# EasyEDA Pro project balance_car.eprj, schematic Schematic2
Board Name: 2_电源板; Create Date: 2024-08-03; Page Name: P1; Project Name: balance_car; Schematic Name: Schematic2; Update Date: 2024-08-20
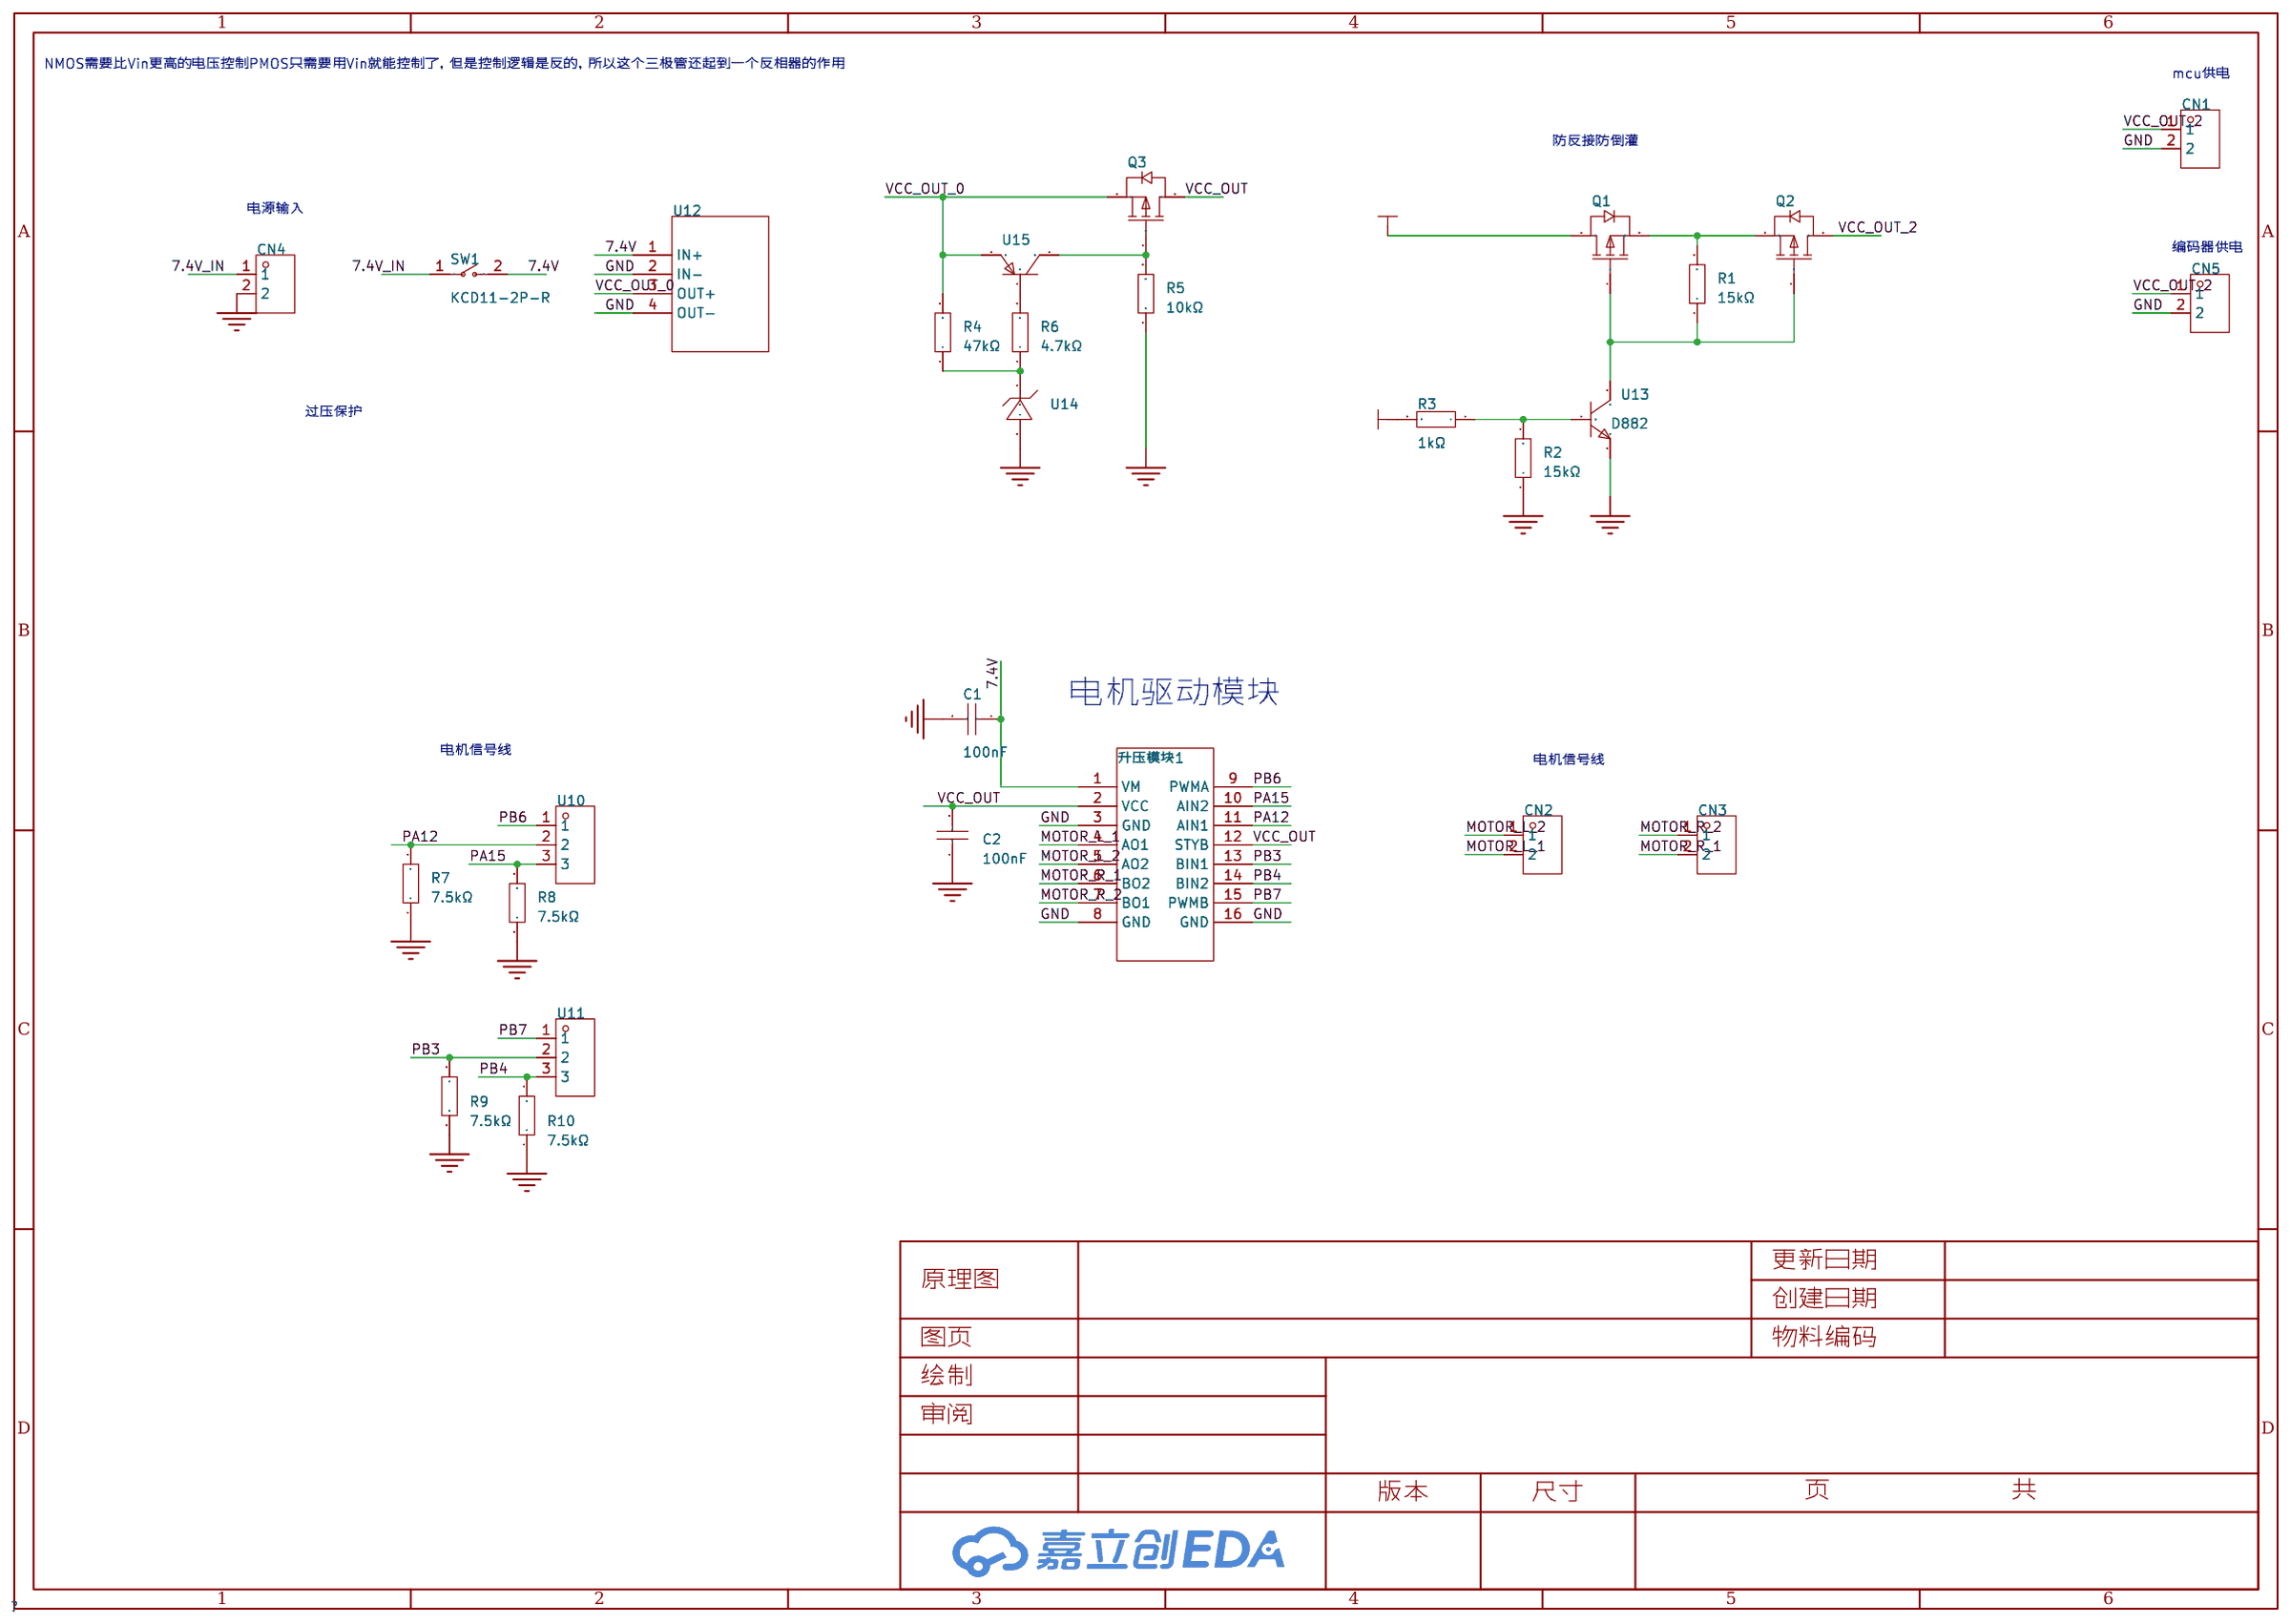
[diagram p0: schematic sheet]

## Parts
C1  100nF  [C1206]
C2  100nF  [C1206]
CN1  ZX-XH2.54-2PZZ  [CONN-TH_2P-P2.50_HX25003-2A]
CN2  ZX-XH2.54-2PZZ  [CONN-TH_2P-P2.50_HX25003-2A]
CN3  ZX-XH2.54-2PZZ  [CONN-TH_2P-P2.50_HX25003-2A]
CN4  ZX-XH2.54-2PZZ  [CONN-TH_2P-P2.50_HX25003-2A]
CN5  ZX-XH2.54-2PZZ  [CONN-TH_2P-P2.50_HX25003-2A]
Q1  AO3401A  [SOT-23_L2.9-W1.3-P1.90-LS2.4-BR]
Q2  AO3401A  [SOT-23_L2.9-W1.3-P1.90-LS2.4-BR]
Q3  AO3401A  [SOT-23_L2.9-W1.3-P1.90-LS2.4-BR]
R1  15kΩ  [R0805]
R2  15kΩ  [R0805]
R3  1kΩ  [R0805]
R4  47kΩ  [R0805]
R5  10kΩ  [R0805]
R6  4.7kΩ  [R0805]
R7  7.5kΩ  [R0603]
R8  7.5kΩ  [R0603]
R9  7.5kΩ  [R0603]
R10  7.5kΩ  [R0603]
SW1  KCD11-2P-R  [SW-TH_2P-L15.0-W10.5-P5.00_KCD11-2P-R]
U10  ZX-XH2.54-3PZZ  [CONN-TH_3P-P2.54_2501S-3P]
U11  ZX-XH2.54-3PZZ  [CONN-TH_3P-P2.54_2501S-3P]
U12  -  [buck_tb]
U13  D882  [SOT-89-3_L4.5-W2.5-P1.50-LS4.0-BR]
U14  ZMM4V7  [LL-34_L3.5-W1.5-RD]
U15  SS8550  [SOT-23-3_L2.9-W1.3-P1.90-LS2.4-BR]
升压模块1  -  [TB6612FNG]

## Library data of the parts
C1 C2 = GRM31C5C1H104JA01L: LCSC Part Name: 100nF ±5% 50V; Supplier Part: C97946; Manufacturer: muRata(村田); Supplier Footprint: 1206; JLCPCB Part Class: 扩展库; Datasheet: https://atta.szlcsc.com/upload/public/pdf/source/20180228/C97946_15198056954501377706.pdf; Supplier: LCSC; Tolerance: ±5%; Voltage Rated: 50V; Temperature Coefficient: C0G
CN1-CN5 = ZX-XH2.54-2PZZ: 插针结构:1x2P;间距:2.54mm;安装方式:直插;参考系列:XH;总PIN数:2P;排数:1;每排PIN数:2;行距:-;额定电流:3A;触头材质:黄铜;触头镀层:锡;工作温度范围:-25℃~+85℃;; Supplier Part: C7429632; Manufacturer: Megastar(兆星); Supplier Footprint: 插件,P=2.54mm; JLCPCB Part Class: 扩展库; Datasheet: https://atta.szlcsc.com/upload/public/pdf/source/20230619/19BA6947230AA44A04D3EDD65E618FD0.pdf; Supplier: LCSC; Pins Structure: 1x2P; Pitch: 2.54mm; Mounting Style: 直插; Reference Series: XH; Number of Pins: 2P; Number of Rows: 1; Number of PINs Per Row: 2; Current Rating (Max): 3A; Contact Material: 黄铜; Contact Plating: 锡; Operating Temperature Range: -25℃~+85℃
Q1-Q3 = AO3401A_C15127: LCSC Part Name: 1个P沟道 耐压:30V 电流:4A; Supplier Part: C15127; Manufacturer: AOS; Supplier Footprint: SOT-23; JLCPCB Part Class: 基础库; Datasheet: https://atta.szlcsc.com/upload/public/pdf/source/20160507/1462613609053.pdf; Supplier: LCSC; Type: 1个P沟道; Drain Source Voltage (Vdss): 30V; Continuous Drain Current (Id): 4A; Power Dissipation (Pd): 1.4W; Drain Source On Resistance (RDS(on)@Vgs,Id): 44mΩ@10V,4.3A; Gate Threshold Voltage (Vgs(th)@Id): 1.3V@250uA; Total Gate Charge (Qg@Vgs): 12.2nC@4.5V; Input Capacitance (Ciss@Vds): 1.2nF@15V; Operating Temperature: -55℃~+150℃@(Tj)
R1-R3 R5 = 0805W8J0103T5E: LCSC Part Name: 10kΩ ±5% 125mW 厚膜电阻; Supplier Part: C25612; Manufacturer: UNI-ROYAL(厚声); Supplier Footprint: 0805; JLCPCB Part Class: 扩展库; Datasheet: https://atta.szlcsc.com/upload/public/pdf/source/20200306/C422600_1E6D84923E4A46A82E41ADD87F860B5C.pdf; Supplier: LCSC; Type: 厚膜电阻; Tolerance: ±5%; Power(Watts): 125mW; Overload Voltage (Max): 150V; Temperature Coefficient: ±100ppm/℃; Operating Temperature Range: -55℃~+155℃
R4 = 0805W8F4702T5E: LCSC Part Name: 47kΩ ±1% 125mW 厚膜电阻; Supplier Part: C17713; Manufacturer: UNI-ROYAL(厚声); Supplier Footprint: 0805; JLCPCB Part Class: 基础库; Datasheet: https://atta.szlcsc.com/upload/public/pdf/source/20200306/C422600_1E6D84923E4A46A82E41ADD87F860B5C.pdf; Supplier: LCSC; Type: 厚膜电阻; Tolerance: ±1%; Power(Watts): 125mW; Overload Voltage (Max): 150V; Temperature Coefficient: ±100ppm/℃; Operating Temperature Range: -55℃~+155℃
R6 = 0805W8F4701T5E: LCSC Part Name: 4.7kΩ ±1% 125mW 厚膜电阻; Supplier Part: C17673; Manufacturer: UNI-ROYAL(厚声); Supplier Footprint: 0805; JLCPCB Part Class: 基础库; Datasheet: https://atta.szlcsc.com/upload/public/pdf/source/20200306/C422600_1E6D84923E4A46A82E41ADD87F860B5C.pdf; Supplier: LCSC; Type: 厚膜电阻; Tolerance: ±1%; Power(Watts): 125mW; Overload Voltage (Max): 150V; Temperature Coefficient: ±100ppm/℃; Operating Temperature Range: -55℃~+155℃
R7-R10 = 0603WAF7501T5E: LCSC Part Name: 7.5kΩ ±1% 100mW 厚膜电阻; Supplier Part: C23234; Manufacturer: UNI-ROYAL(厚声); Supplier Footprint: 0603; JLCPCB Part Class: 基础库; Datasheet: https://atta.szlcsc.com/upload/public/pdf/source/20200306/C422600_1E6D84923E4A46A82E41ADD87F860B5C.pdf; Supplier: LCSC; Type: 厚膜电阻; Tolerance: ±1%; Power(Watts): 100mW; Overload Voltage (Max): 75V; Temperature Coefficient: ±100ppm/℃; Operating Temperature Range: -55℃~+155℃
SW1 = KCD11-2P-R: LCSC Part Name: 10.5*15mm 两脚两档跷板开关 红钮; Supplier Part: C5884414; Manufacturer: SHOU HAN(首韩); Supplier Footprint: 插件; JLCPCB Part Class: 扩展库; Datasheet: https://atta.szlcsc.com/upload/public/pdf/source/20230506/CD06DFDE35C8048D34175BFF4AF6A2C2.pdf; Supplier: LCSC; Switch Length: 15mm; Switch Width: 10.5mm; Switch Height: 17.2mm; Actuator Type: 凹面弯曲; With Lamp: 无; Pin Style: 焊片; Actuator Color: 红色; Contact Current: 3A; Voltage Rating (AC): 250V; Circuit: 单刀单掷; Mechanical Life: 1万次; Operating Temperature: 0℃~+125℃; Actuator Identifier: - O
U10 U11 = ZX-XH2.54-3PZZ: 插针结构:1x3P;间距:2.54mm;安装方式:直插;参考系列:XH;总PIN数:3P;排数:1;每排PIN数:3;行距:-;额定电流:3A;触头材质:黄铜;触头镀层:锡;工作温度范围:-25℃~+85℃;; Supplier Part: C7429633; Manufacturer: Megastar(兆星); Supplier Footprint: 插件,P=2.54mm; JLCPCB Part Class: 扩展库; Datasheet: https://atta.szlcsc.com/upload/public/pdf/source/20230619/AE17037A2CFDBE8D9CBA775D61AD0A84.pdf; Supplier: LCSC; Pins Structure: 1x3P; Pitch: 2.54mm; Mounting Style: 直插; Reference Series: XH; Number of Pins: 3P; Number of Rows: 1; Number of PINs Per Row: 3; Current Rating (Max): 3A; Contact Material: 黄铜; Contact Plating: 锡; Operating Temperature Range: -25℃~+85℃
U12 = buck_tb
U13 = D882_C5279057: Supplier Part: C5279057; Manufacturer: TWGMC(台湾迪嘉); Supplier Footprint: SOT-89; JLCPCB Part Class: 扩展库; Datasheet: https://atta.szlcsc.com/upload/public/pdf/source/20221123/96DFFD4BB7BF04F439C1CE05ED0C7D51.pdf; Supplier: LCSC
U14 = ZMM4V7_C5345991: Supplier Part: C5345991; Manufacturer: HXY MOSFET(华轩阳电子); Supplier Footprint: LL-34; JLCPCB Part Class: 扩展库; Datasheet: https://atta.szlcsc.com/upload/public/pdf/source/20230112/6AB296F017D3081BCBF43BE0653A5C9A.pdf; Supplier: LCSC; Diode Configuration: 独立式; Zener Voltage (Nom): 4.7V; Reverse Leakage Current (Ir): 500nA@1V; Zener Voltage (Range): 4.4V~5V; Power Dissipation: 500mW; Zener Impedance (Zzt): 60Ω
U15 = SS8550_C7420371: LCSC Part Name: 耐压:25V 电流:1.5A PNP H档 200-350; Supplier Part: C7420371; Manufacturer: 宏迦橙; Supplier Footprint: SOT-23; JLCPCB Part Class: 扩展库; Datasheet: https://atta.szlcsc.com/upload/public/pdf/source/20231222/5BDA6DBF3A79C59009F81F0EEE6F8969.pdf; Supplier: LCSC; Transistor Type: PNP; Collector Current (Ic): 1.5A; Collector-Emitter Breakdown Voltage (Vceo): 25V; Power Dissipation (Pd): 300mW; DC Current Gain (hFE@Ic,Vce): 120@100mA,1.0V; Transition Frequency (fT): 100MHz; Collector Cut-Off Current (Icbo): 100nA; Collector-Emitter Saturation Voltage (VCE(sat)@Ic,Ib): 500mV@800mA,80mA; Operating Temperature: -55℃~+150℃
升压模块1 = TB6612FNG

## Nets
7.4V: C1.1 SW1.2 U12.1(IN+) 升压模块1.1(VM)
7.4V_IN: CN4.1 SW1.1
GND: C1.2 C2.1 CN1.2 CN4.2 CN5.2 R2.1 R5.1 R7.1 R8.1 R9.1 R10.1 U12.2(IN-) U12.4(OUT-) U13.3(E) U14.2(A) 升压模块1.3(GND) 升压模块1.8(GND) 升压模块1.16(GND)
VCC_OUT: C2.2 Q1.3(D) Q3.3(D) R3.2 升压模块1.2(VCC) 升压模块1.12(STYB)
VCC_OUT_0: Q3.2(S) R4.2 U12.3(OUT+) U15.2(E)
VCC_OUT_2: CN1.1 CN5.1 Q2.3(D)
MOTOR_L_1: CN2.2 升压模块1.4(AO1)
MOTOR_L_2: CN2.1 升压模块1.5(AO2)
MOTOR_R_1: CN3.2 升压模块1.6(BO2)
MOTOR_R_2: CN3.1 升压模块1.7(BO1)
PA12: R7.2 U10.2 升压模块1.11(AIN1)
PA15: R8.2 U10.3 升压模块1.10(AIN2)
PB3: R9.2 U11.2 升压模块1.13(BIN1)
PB4: R10.2 U11.3 升压模块1.14(BIN2)
PB6: U10.1 升压模块1.9(PWMA)
PB7: U11.1 升压模块1.15(PWMB)
$1N2989: Q1.2(S) Q2.2(S) R1.2
$1N3076: Q1.1(G) Q2.1(G) R1.1 U13.2(C)
$1N3246: R2.2 R3.1 U13.1(B)
$1N4292: R6.2 U15.1(B)
$1N4294: R4.1 R6.1 U14.1(C)
$1N4296: Q3.1(G) R5.2 U15.3(C)

## Notes on the sheet
- NMOS需要比Vin更高的电压控制PMOS只需要用Vin就能控制了，但是控制逻辑是反的，所以这个三极管还起到一个反相器的作用
- mcu供电
- 防反接防倒灌
- 电源输入
- 编码器供电
- 过压保护
- 电机驱动模块
- 电机信号线
- 电机信号线
